# EasyEDA Pro project kuafu01_030内部老化方案_2.eprj

# Schematic Schematic1

## Sheets
1 P1: Create Date: 2023-03-22; Page Name: P1; Project Name: kuafu01_030内部老化方案_2; Schematic Name: Schematic1; Update Date: 2023-04-24; Company: 嘉立创EDA; Page Size: A4; Version: V1.0
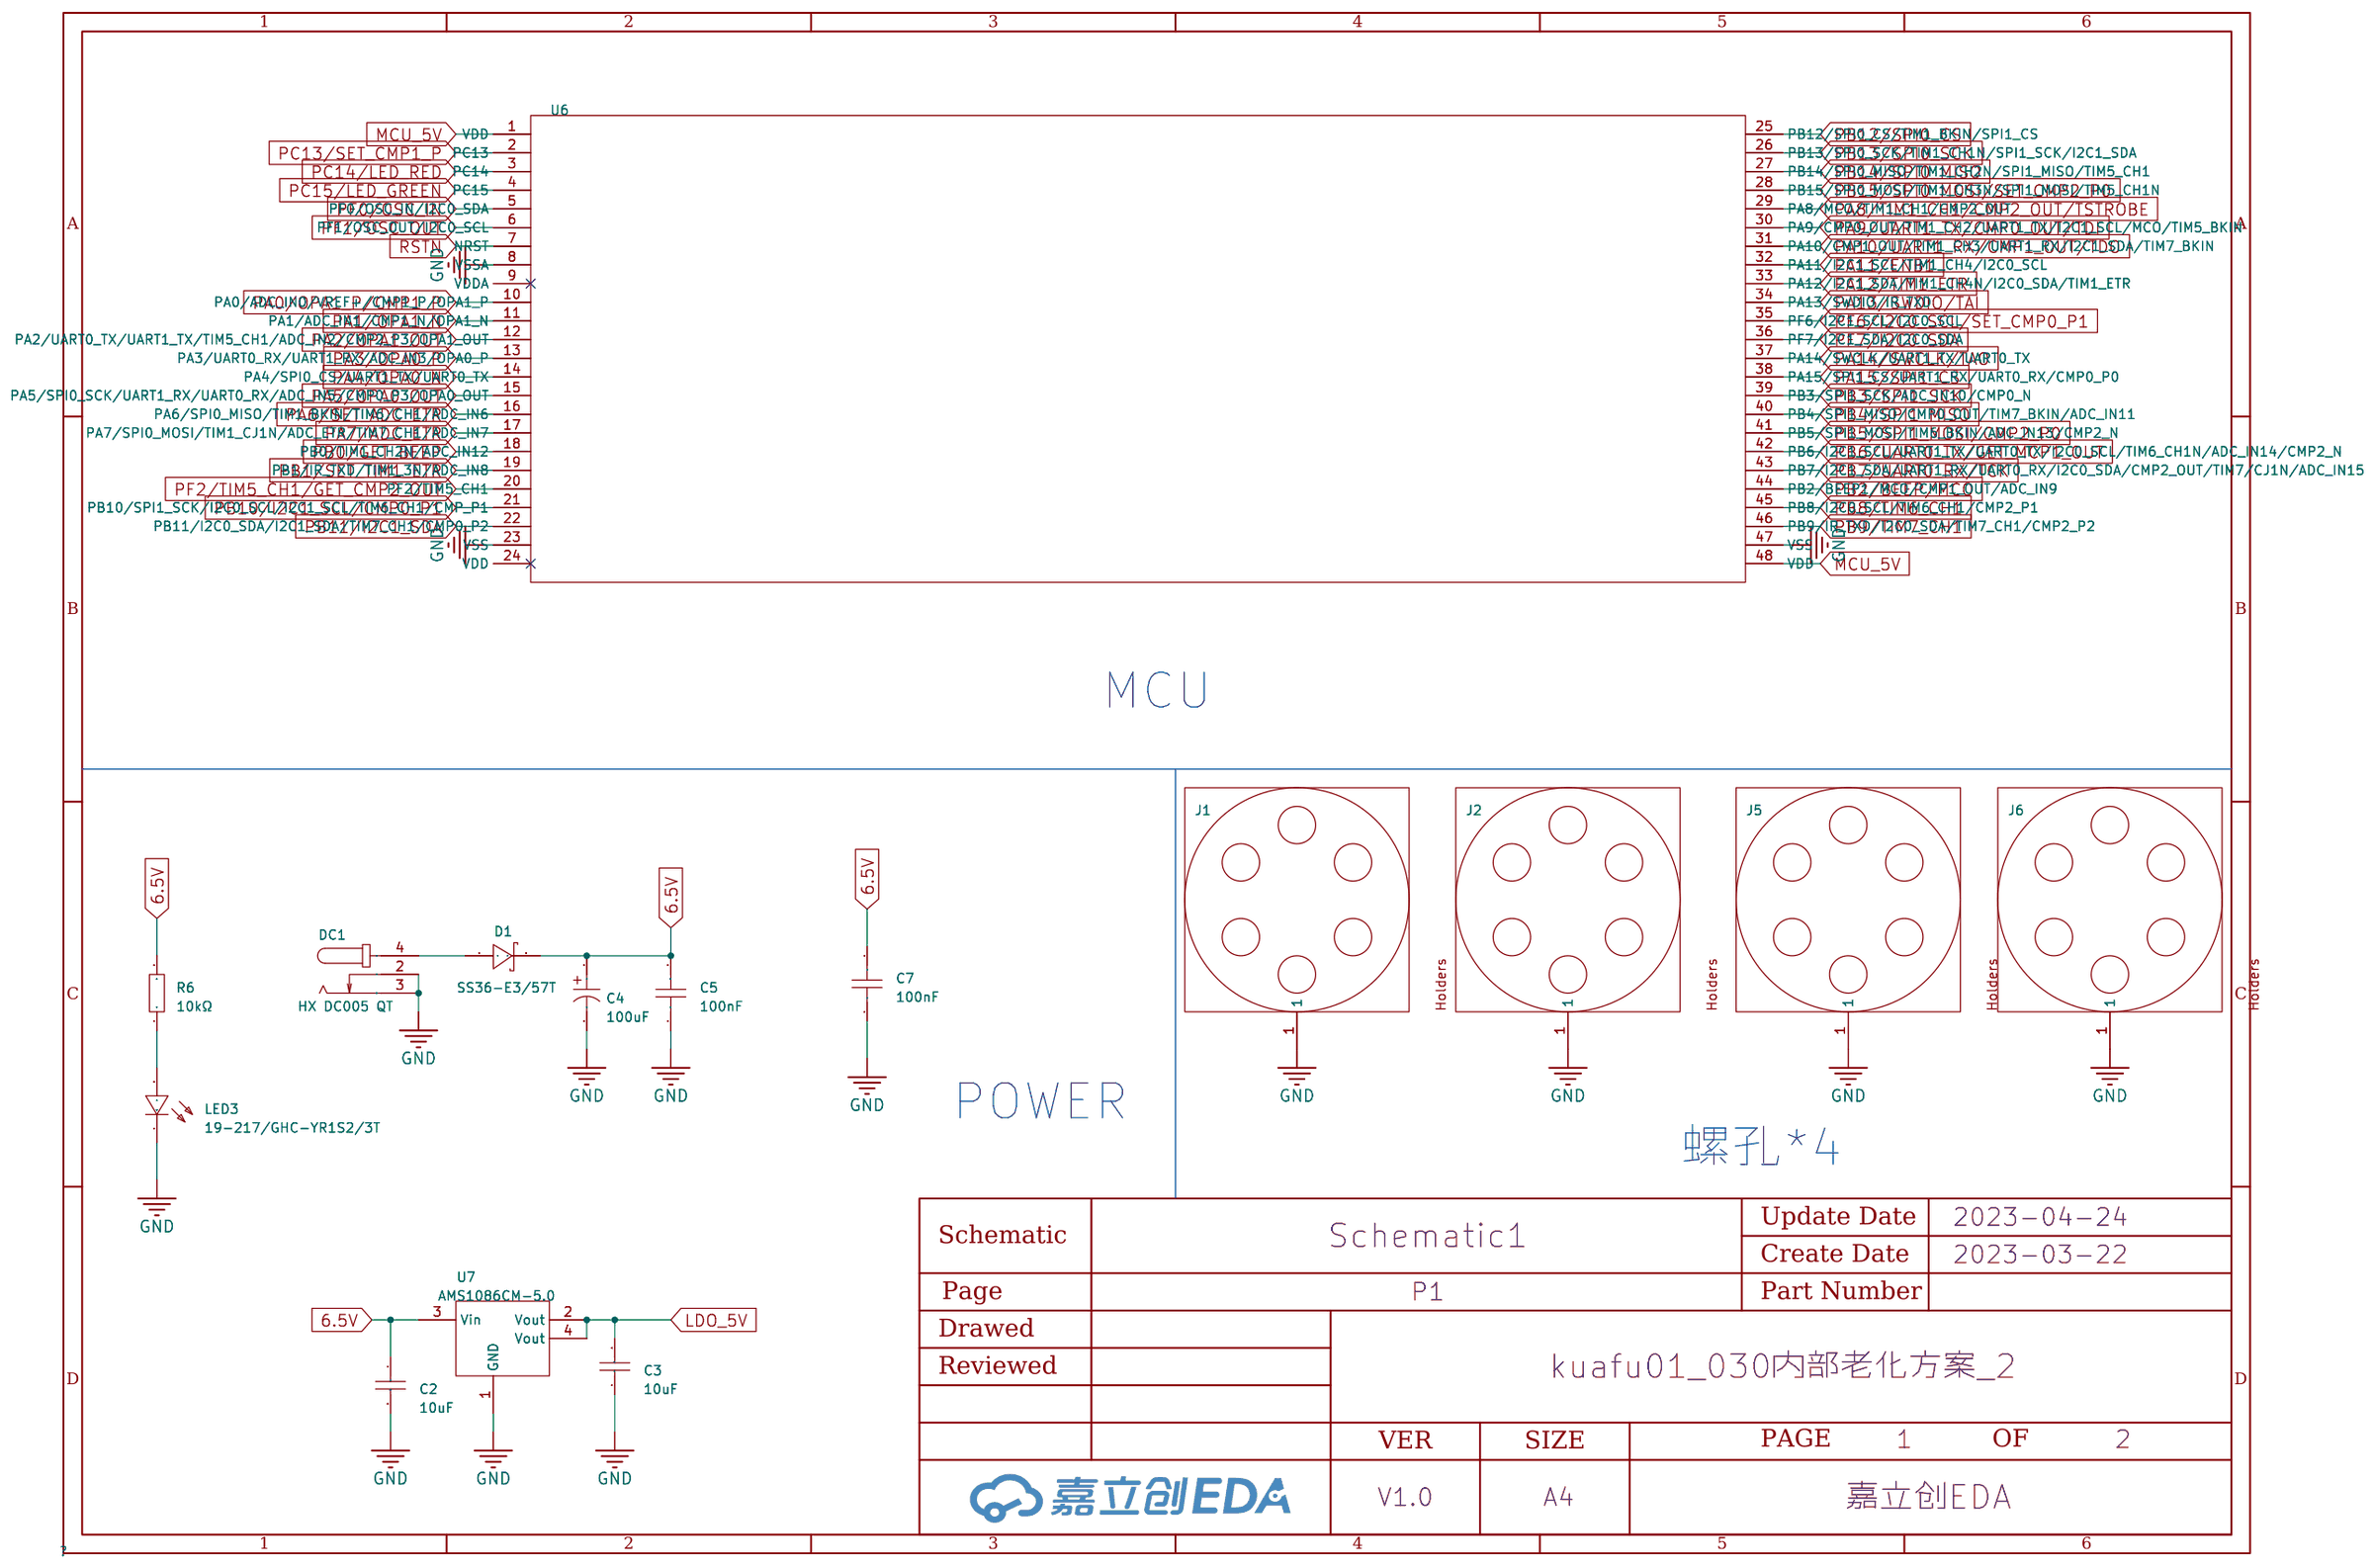
[diagram p0: P1]
2 P2: Create Date: 2023-03-27; Page Name: P2; Update Date: 2023-04-25
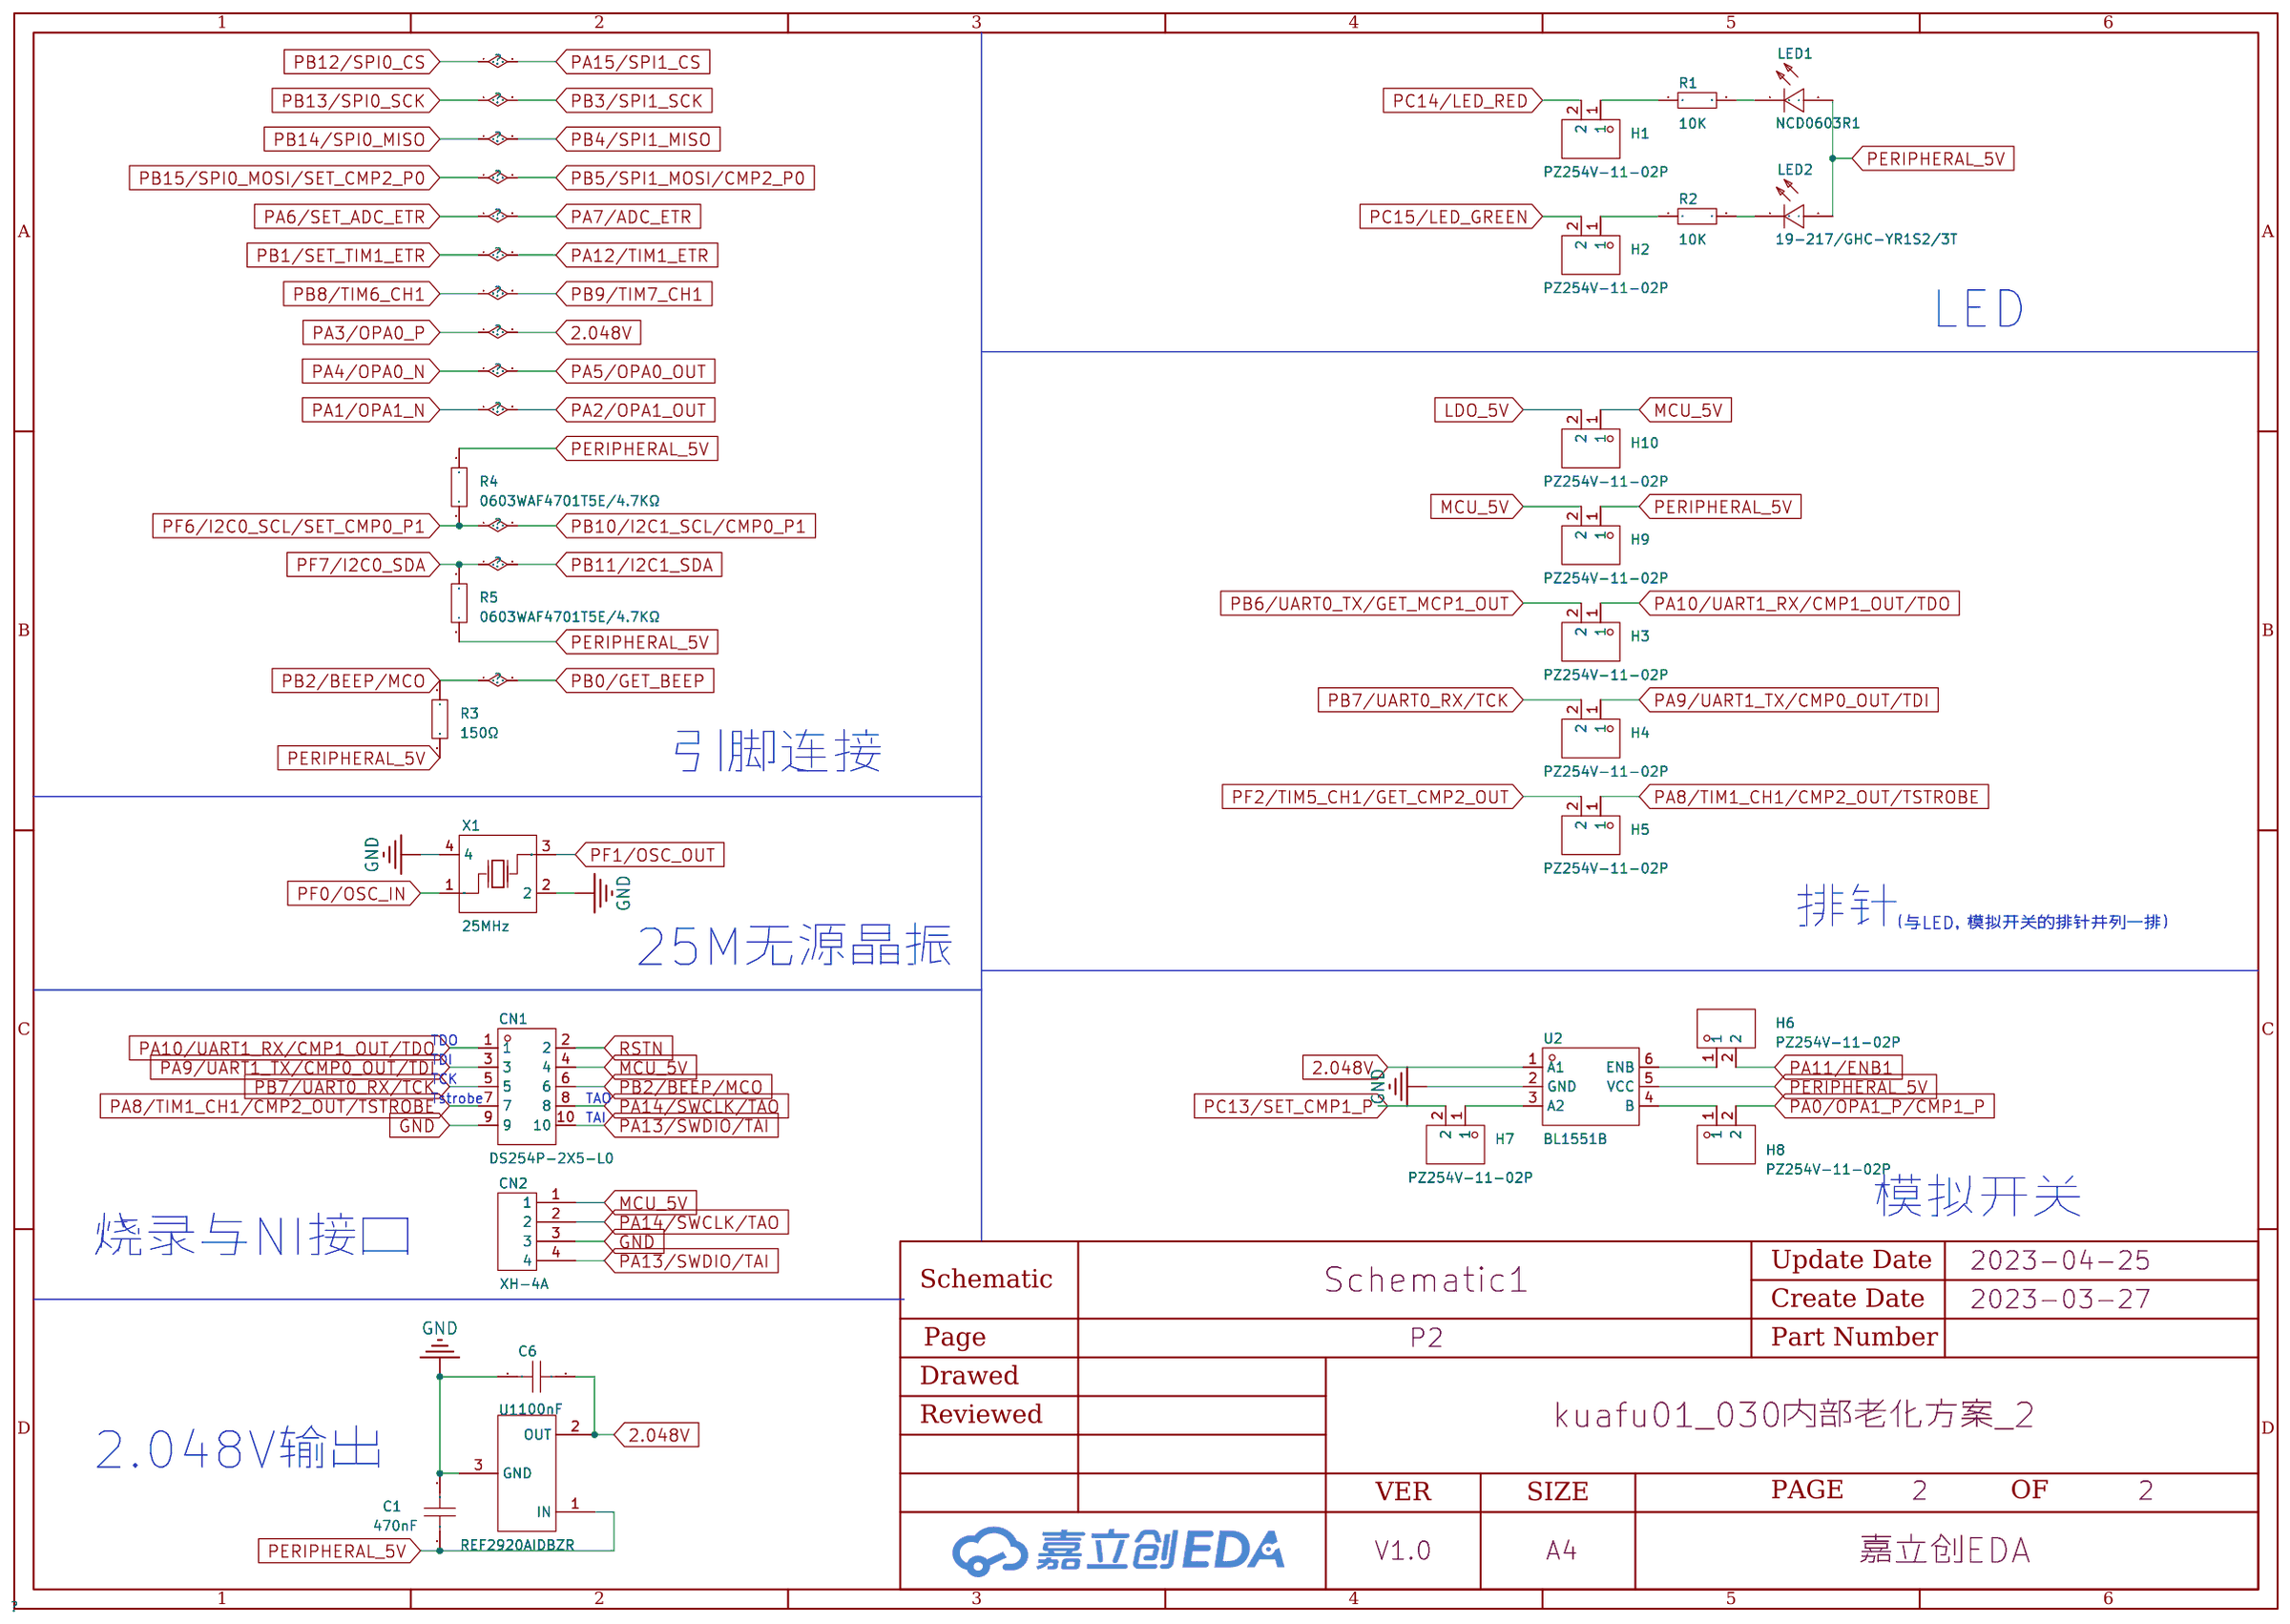
[diagram p1: P2]

## Parts
sheet P1
C2  10uF  [C1206]
C3  10uF  [C1206]
C4  100uF  [CAP-SMD_BD6.3-L6.6-W6.6-LS7.6-FD-1]
C5  100nF  [C0603]
C7  100nF  [C0603]
D1  SS36-E3/57T  [SMC_L7.1-W6.2-LS8.1-R-RD]
DC1  HX DC005 QT  [DC-IN-TH_HANXIA_HX-DC005-QT]
J1  -  [DEMO板安装孔]
J2  -  [DEMO板安装孔]
J5  -  [DEMO板安装孔]
J6  -  [DEMO板安装孔]
LED3  19-217/GHC-YR1S2/3T  [LED0603-RD]
R6  10kΩ  [R0603]
U6  PT32A030C8T7  [LQFP-48_L7.0-W7.0-P0.50-LS9.0-BL-EP5.4]
U7  AMS1086CM-5.0  [TO-263-3_L8.6-W10.2-P2.54-LS14.4-TL]
sheet P2
C1  470nF  [C0603]
C6  100nF  [C0603]
CN1  DS254P-2X5-L0  [IDC-TH_10P-P2.54-V-R2-C5-S2.54]
CN2  XH-4A  [CONN-TH_4P-P2.50_XH-4A]
H1  PZ254V-11-02P  [HDR-TH_2P-P2.54-V-M]
H2  PZ254V-11-02P  [HDR-TH_2P-P2.54-V-M]
H3  PZ254V-11-02P  [HDR-TH_2P-P2.54-V-M]
H4  PZ254V-11-02P  [HDR-TH_2P-P2.54-V-M]
H5  PZ254V-11-02P  [HDR-TH_2P-P2.54-V-M]
H6  PZ254V-11-02P  [HDR-TH_2P-P2.54-V-M]
H7  PZ254V-11-02P  [HDR-TH_2P-P2.54-V-M]
H8  PZ254V-11-02P  [HDR-TH_2P-P2.54-V-M]
H9  PZ254V-11-02P  [HDR-TH_2P-P2.54-V-M]
H10  PZ254V-11-02P  [HDR-TH_2P-P2.54-V-M]
LED1  NCD0603R1  [LED0603-RD_RED]
LED2  19-217/GHC-YR1S2/3T  [LED0603-RD]
R1  10K  [R0603]
R2  10K  [R0603]
R3  150Ω  [R0603]
R4  0603WAF4701T5E/4.7KΩ  [R0603]
R5  0603WAF4701T5E/4.7KΩ  [R0603]
U1  REF2920AIDBZR  [SOT-23-3_L2.9-W1.3-P1.90-LS2.4-BR]
U2  BL1551B  [SC-70-6_L2.1-W1.3-P0.65-LS2.3-BR]
X1  25MHz  [OSC-SMD_4P-L2.5-W2.0-BL]

## Library data of the parts
C2 C3 = CL31A106KBHNNNE: 容值:10uF;精度:±10%;额定电压:50V;材质(温度系数):X5R;; LCSC Part Name: 10uF ±10% 50V; Supplier Part: C13585; Manufacturer: SAMSUNG(三星); Supplier Footprint: 1206; JLCPCB Part Class: Basic Part; Datasheet: https://atta.szlcsc.com/upload/public/pdf/source/20160103/1457707668742.pdf; Supplier: LCSC; Tolerance: ±10%; Voltage Rated: 50V; Temperature Coefficient: X5R
C4 = RVE100UF35V67RV0072: 容值:100uF;额定电压:35V;电容体直径:-;电容体长度:-;纹波电流:-;等效串联电阻:-;工作寿命:-;; LCSC Part Name: 100uF 35V; Supplier Part: C2836437; Manufacturer: KNSCHA(科尼盛); Supplier Footprint: SMD,6.3x7.7mm; JLCPCB Part Class: Extended Part; Datasheet: https://atta.szlcsc.com/upload/public/pdf/source/20220719/B52EB46F8A1558448ED03D8B4CB3C24F.pdf; Supplier: LCSC; Rated Voltage: 35V
C5-C7 = CL10B104KB8NNNC: 容值:100nF;精度:±10%;额定电压:50V;材质(温度系数):X7R;; LCSC Part Name: 100nF ±10% 50V; Supplier Part: C1591; Manufacturer: SAMSUNG(三星); Supplier Footprint: 0603; JLCPCB Part Class: Extended Part; Datasheet: https://atta.szlcsc.com/upload/public/pdf/source/20160103/1457707680512.pdf; Supplier: LCSC; Tolerance: ±10%; Voltage Rated: 50V; Temperature Coefficient: X7R
D1 = SS36-E3/57T: 直流反向耐压（Vr）:60V;平均整流电流（Io）:3A;正向压降（Vf）:750mV @ 3A;; Supplier Part: C35722; Manufacturer: VISHAY(威世); Supplier Footprint: SMC(DO-214AB); JLCPCB Part Class: Basic Part; Datasheet: https://atta.szlcsc.com/upload/public/pdf/source/20151007/1457707426323.pdf; Supplier: LCSC
DC1 = HX DC005 QT: 连接器类型:DC插座;安装方式:卧插;额定电流:1A;额定电压:12V;工作温度范围:-25℃~+85℃;; LCSC Part Name: DC插座; Supplier Part: C5184829; Manufacturer: hanxia(韩下); Supplier Footprint: 插件; JLCPCB Part Class: Extended Part; Datasheet: https://atta.szlcsc.com/upload/public/pdf/source/20220930/72F2DABD42189BF434FA6ABB0C092A1C.pdf; Supplier: LCSC; Connector Type: DC插座; Mounting Style: 卧插; Current Rating (Max): 1A; Voltage Rating (Max): 12V; Operating Temperature Range: -25℃~+85℃
J1 J2 J5 J6 = 螺孔_3.1X6MM
LED2 LED3 = 19-217/GHC-YR1S2/3T: 发光颜色:翠绿;二极管配置:-;透镜颜色:无色透明;主波长:520nm~535nm;峰值波长:518nm;色温:-;测试电流:20mA;功率:110mW;发光角度:120°;安装方式:-;工作温度:-40℃~+85℃;; LCSC Part Name: 翠绿 520nm~535nm; Supplier Part: C72043; Manufacturer: EVERLIGHT(亿光); Supplier Footprint: 0603; JLCPCB Part Class: Basic Part; Datasheet: https://atta.szlcsc.com/upload/public/pdf/source/20160507/1462613613780.pdf; Supplier: LCSC; Emitted Color: 翠绿; Lens Color: 无色透明; Dominant Wavelength: 520nm~535nm; Peak Wavelength: 518nm; Forward Current: 20mA; Power Dissipation: 110mW; Viewing Angle: 120°; Operating Temperature: -40℃~+85℃
R6 = 0603WAF1002T5E: 电阻类型:厚膜电阻;阻值:10kΩ;精度:±1%;功率:100mW;温度系数:±100ppm/℃;最大工作电压:75V;工作温度范围:-55℃~+155℃;; LCSC Part Name: 10kΩ ±1% 100mW; Supplier Part: C25804; Manufacturer: UNI-ROYAL(厚声); Supplier Footprint: 0603; JLCPCB Part Class: Basic Part; Datasheet: https://atta.szlcsc.com/upload/public/pdf/source/20200306/C422600_1E6D84923E4A46A82E41ADD87F860B5C.pdf; Supplier: LCSC; Type: 厚膜电阻; Tolerance: ±1%; Power(Watts): 100mW; Temperature Coefficient: ±100ppm/℃; Overload Voltage (Max): 75V; Operating Temperature Range: -55℃~+155℃
U6 = PT32A030C8T7
U7 = AMS1086CM-5.0: 输出类型:固定;输出极性:正;最大输入电压:15V;输出电压:5V;输出电流:1.5A;电源纹波抑制比(PSRR):68dB@(120Hz);; LCSC Part Name: 输入15V 输出5V 1.5A; Supplier Part: C27631; Manufacturer: AMS; Supplier Footprint: TO-263-3; JLCPCB Part Class: Extended Part; Datasheet: https://atta.szlcsc.com/upload/public/pdf/source/20140314/1457707017583.pdf; Supplier: LCSC; Output Type: 固定; Output Polarity: 正; Number of Outputs: 1; Maximum Input Voltage: 15V; Output Voltage: 5V; Dropout Voltage: 1.5V@(1.5A); Output Current: 1.5A; Power Supply Rejection Ratio (PSRR): 68dB@(120Hz)
C1 = CAP_0603: Supplier Footprint: 0603
CN1 = DS254P-2X5-L0: 封装形式:直插;; Supplier Part: C4749194; Manufacturer: DEALON(德艺隆); Supplier Footprint: 直插,P=2.54mm; JLCPCB Part Class: Extended Part; Datasheet: https://atta.szlcsc.com/upload/public/pdf/source/20220715/65B607CBB33C24A1E64FE679E68C8AAF.pdf; Supplier: LCSC; Holder Type: 直插
CN2 = XH-4A_C37815: 参考系列:XH;间距:2.5mm;插针结构:1x4P;排数:1;每排PIN数:4;行距:-;安装方式:-;触头材质:磷青铜;; LCSC Part Name: XH 2.5mm 1x4P; Supplier Part: C37815; Manufacturer: BOOMELE(博穆精密); Supplier Footprint: 插件,P=2.5mm; JLCPCB Part Class: Extended Part; Datasheet: https://atta.szlcsc.com/upload/public/pdf/source/20170919/C37815_1505787307039977083.pdf; Supplier: LCSC; Reference Series: XH; Pitch: 2.5mm; Pins Structure: 1x4P; Number of Rows: 1; Number of PINs Per Row: 4; Contact Material: 磷青铜
H1-H10 = PZ254V-11-02P: 排数:单排;总PIN位数:2;间距:2.54mm;插针结构:1x2P;行距:-;安装类型:直插;圆针/方针:方针;额定电流:-;额定电压:-;配合针长度:6mm;塑高:2.5mm;端接针长度:3mm;触头材质:黄铜;触头镀层:-;工作温度范围:-40℃~+105℃;颜色:黑色;; LCSC Part Name: 2.54mm 1x2P 直插 方针; Supplier Part: C492401; Manufacturer: XFCN(兴飞); Supplier Footprint: 直插,P=2.54mm; JLCPCB Part Class: Extended Part; Datasheet: https://atta.szlcsc.com/upload/public/pdf/source/20200309/C492401_A812433581A9B211A7FFA413ADDFF0E5.pdf; Supplier: LCSC; Number of Rows: 单排; Number of Pins: 2; Pitch: 2.54mm; Pin Structure: 1x2P; Mounting Type: 直插; Circluar Pins/Square Pins: 方针; Length of Mating Pin: 6mm; Insulation Height: 2.5mm; Length of End Connection Pin: 3mm; Contact Material: 黄铜; Operating Temperature Range: -40℃~+105℃; Color: 黑色
LED1 = NCD0603R1_C84263: 发光颜色:红灯;; LCSC Part Name: 红灯; Supplier Part: C84263; Manufacturer: 国星光电; Supplier Footprint: 0603; JLCPCB Part Class: Extended Part; Datasheet: https://atta.szlcsc.com/upload/public/pdf/source/20200820/C84263_DABC6A75E58F576973B407FDBA283D60.pdf; Supplier: LCSC; Emitted Color: 红灯
R1-R3 = Res_0603: Supplier Footprint: 0603
R4 R5 = 0603WAF4701T5E: LCSC Part Name: 4.7KΩ(4701) ±1% 编带; Supplier Part: C23162; Manufacturer: UNI-ROYAL(厚声); Supplier Footprint: 0603; JLCPCB Part Class: Basic Part; Datasheet: https://atta.szlcsc.com/upload/public/pdf/source/20170920/C23162_1505901109673982545.pdf; Supplier: LCSC
U1 = REF2920AIDBZR: 电压基准类型:串联;输出类型:固定;输入电压:2.098V~5.5V;输出电流:25mA;精度:±2%;温度系数:100ppm/℃;静态电流:59uA;噪声(0.1Hz-10Hz):23uVp-p;噪声(10Hz-10kHz):65uVrms;工作温度:-40℃~+125℃@(Ta);; LCSC Part Name: 串联 25mA; Supplier Part: C111863; Manufacturer: TI(德州仪器); Supplier Footprint: SOT-23; JLCPCB Part Class: Extended Part; Datasheet: https://atta.szlcsc.com/upload/public/pdf/source/20170919/C111863_1505787059229976692.pdf; Supplier: LCSC; Reference Type: 串联; Output Type: 固定; Input Voltage: 2.098V~5.5V; Output Current: 25mA; Tolerance: ±2%; Temperature Coefficient: 100ppm/℃; Supply Current: 59uA; Noise - 1/10Hz to 10Hz: 23uVp-p; Noise - 10Hz to 10kHz: 65uVrms; Operating Temperature: -40℃~+125℃@(Ta)
U2 = BL1551B: Supplier Part: C2944066; Manufacturer: BL(上海贝岭); Supplier Footprint: SC-70-6; JLCPCB Part Class: Extended Part; Datasheet: https://atta.szlcsc.com/upload/public/pdf/source/20220111/7C5AAA5FC97DA844C85990CC55D99B47.pdf; Supplier: LCSC
X1 = ECS-250-10-36Q-AES-TR: 晶振类型:-;频率:25MHz;频率公差:±25ppm;频率稳定度:±50ppm;负载电容:10pF;等效串联电阻(ESR):60Ω;工作温度:-40℃~+125℃;; LCSC Part Name: 25MHz ±25ppm 10pF; Supplier Part: C435199; Manufacturer: ECS; Supplier Footprint: SMD2520-4P; JLCPCB Part Class: Extended Part; Datasheet: https://atta.szlcsc.com/upload/public/pdf/source/20200102/C435199_2BF86DF6FEC67718933C4FC174F98801.pdf; Supplier: LCSC; Frequency Tolerance: ±25ppm; Frequency Stability: ±50ppm; Load Capacitance: 10pF; Equivalent Series Resistance (ESR): 60Ω; Operating Temperature: -40℃~+125℃

## Nets
2.048V: C6.2 U1.2(OUT) U2.1(A1) U6.13(PA3/UART0_RX/UART1_RX/ADC_IN3/OPA0_P)
6.5V: C2.1 C4.1 C5.2 C7.2 D1.2(K) R6.2 U7.3(Vin)
GND: C1.2 C2.2 C3.1 C4.2 C5.1 C6.1 C7.1 CN1.9 CN2.3 DC1.2 DC1.3 J1.1 J2.1 J5.1 J6.1 LED3.1(C) U1.3(GND) U2.2(GND) U6.8(VSSA) U6.23(VSS) U6.47(VSS) U7.1(GND) X1.2 X1.4
LDO_5V: C3.2 H10.2 U7.2(Vout) U7.4(Vout)
MCU_5V: CN1.4 CN2.1 H9.2 H10.1 U6.1(VDD) U6.48(VDD)
PA0/OPA1_P/CMP1_P: H8.2 U6.10(PA0/ADC_IN0/VREF+/CMP1_P/OPA1_P)
PA1/OPA1_N: U6.11(PA1/ADC_IN1/CMP1_N/OPA1_N) U6.12(PA2/UART0_TX/UART1_TX/TIM5_CH1/ADC_IN2/CMP2_P3/OPA1_OUT)
PA4/OPA0_N: U6.14(PA4/SPI0_CS/UART1_TX/UART0_TX) U6.15(PA5/SPI0_SCK/UART1_RX/UART0_RX/ADC_IN5/CMP0_P3/OPA0_OUT)
PA6/SET_ADC_ETR: U6.16(PA6/SPI0_MISO/TIM1_BKIN/TIM6/CH1/ADC_IN6) U6.17(PA7/SPI0_MOSI/TIM1_CJ1N/ADC_ETR/TIM7_CH1/ADC_IN7)
PA8/TIM1_CH1/CMP2_OUT/TSTROBE: CN1.7 H5.1 U6.29(PA8/MCO/TIM1_CH1/CMP2_OUT)
PA9/UART1_TX/CMP0_OUT/TDI: CN1.3 H4.1 U6.30(PA9/CMP0_OUT/TIM1_CH2/UART1_TX/I2C1_SCL/MCO/TIM5_BKIN)
PA10/UART1_RX/CMP1_OUT/TDO: CN1.1 H3.1 U6.31(PA10/CMP1_OUT/TIM1_CH3/UART1_RX/I2C1_SDA/TIM7_BKIN)
PA11/ENB1: H6.2 U6.32(PA11/I2C1_SCL/TIM1_CH4/I2C0_SCL)
PA12/TIM1_ETR: U6.19(PB1/IR_TXD/TIM1_3N/ADC_IN8) U6.33(PA12/I2C1_SDA/TIM1_CH4N/I2C0_SDA/TIM1_ETR)
PA13/SWDIO/TAI: CN1.10 CN2.4 U6.34(PA13/SWDIO/IR_TXD)
PA14/SWCLK/TAO: CN1.8 CN2.2 U6.37(PA14/SWCLK/UART1_TX/UART0_TX)
PA15/SPI1_CS: U6.25(PB12/SPI0_CS/TIM1_BKIN/SPI1_CS) U6.38(PA15/SPI1_CS/UART1_RX/UART0_RX/CMP0_P0)
PB0/GET_BEEP: CN1.6 R3.2 U6.18(PB0/TIM1_CH2N/ADC_IN12) U6.44(PB2/BEEP1/MCO/CMP1_OUT/ADC_IN9)
PB6/UART0_TX/GET_MCP1_OUT: H3.2 U6.42(PB6/I2C1_SCL/UART1_TX/UART0_TX/I2C0_SCL/TIM6_CH1N/ADC_IN14/CMP2_N)
PB7/UART0_RX/TCK: CN1.5 H4.2 U6.43(PB7/I2C1_SDA/UART1_RX/UART0_RX/I2C0_SDA/CMP2_OUT/TIM7/CJ1N/ADC_IN15)
PB8/TIM6_CH1: U6.45(PB8/I2C0_SCL/TIM6_CH1/CMP2_P1) U6.46(PB9/IR_TXD/I2C0_SDA/TIM7_CH1/CMP2_P2)
PB10/I2C1_SCL/CMP0_P1: R4.2 U6.21(PB10/SPI1_SCK/I2C0_SCL/I2C1_SCL/TIM6_CH1/CMP_P1) U6.35(PF6/I2C1_SCL/I2C0_SCL)
PB11/I2C1_SDA: R5.1 U6.22(PB11/I2C0_SDA/I2C1_SDA/TIM7_CH1/CMP0_P2) U6.36(PF7/I2C1_SDA/I2C0_SDA)
PB13/SPI0_SCK: U6.26(PB13/SPI0_SCK/TIM1_CH1N/SPI1_SCK/I2C1_SDA) U6.39(PB3/SPI1_SCK/ADC_IN10/CMP0_N)
PB14/SPI0_MISO: U6.27(PB14/SPI0_MISO/TIM1_CH2N/SPI1_MISO/TIM5_CH1) U6.40(PB4/SPI1_MISO/CMP0_OUT/TIM7_BKIN/ADC_IN11)
PB15/SPI0_MOSI/SET_CMP2_P0: U6.28(PB15/SPI0_MOSI/TIM1_CH3N/SPI1_MOSI/TIM5_CH1N) U6.41(PB5/SPI1_MOSI/TIM6_BKIN/ADC_IN13/CMP2_N)
PC13/SET_CMP1_P: H7.2 U6.2(PC13)
PC14/LED_RED: H1.2 U6.3(PC14)
PC15/LED_GREEN: H2.2 U6.4(PC15)
PERIPHERAL_5V: C1.1 H9.1 LED1.2(A) LED2.2(A) R3.1 R4.1 R5.2 U1.1(IN) U2.5(VCC)
PF0/OSC_IN: U6.5(PF0/OSC_IN/I2C0_SDA) X1.1(OSC1)
PF1/OSC_OUT: U6.6(PF1/OSC_OUT/I2C0_SCL) X1.3(OSC2)
PF2/TIM5_CH1/GET_CMP2_OUT: H5.2 U6.20(PF2/TIM5_CH1)
RSTN: CN1.2 U6.7(NRST)
$3N9153: D1.1(A) DC1.4
$3N9301: LED3.2(A) R6.1
$4N6329: LED2.1(C) R2.2
$4N6330: LED1.1(K) R1.2
$4N10186: H7.1 U2.3(A2)
$4N10193: H6.1 U2.6(ENB)
$4N10258: H2.1 R2.1
$4N10262: H1.1 R1.1
$4N16114: H8.1 U2.4(B)

Not connected (* = marked no-connect by the designer): U6 9(VDDA)* 24(VDD)*

## Notes on the sheets
sheet 1
- MCU
- POWER
- 螺孔*4
sheet 2
- LED
- 引脚连接
- 排针
- （与LED，模拟开关的排针并列一排）
- 25M无源晶振
- TDO
- TDI
- TCK
- Tstrobe
- TAO
- TAI
- 模拟开关
- 烧录与NI接口
- 2.048V输出

# Board PCB4
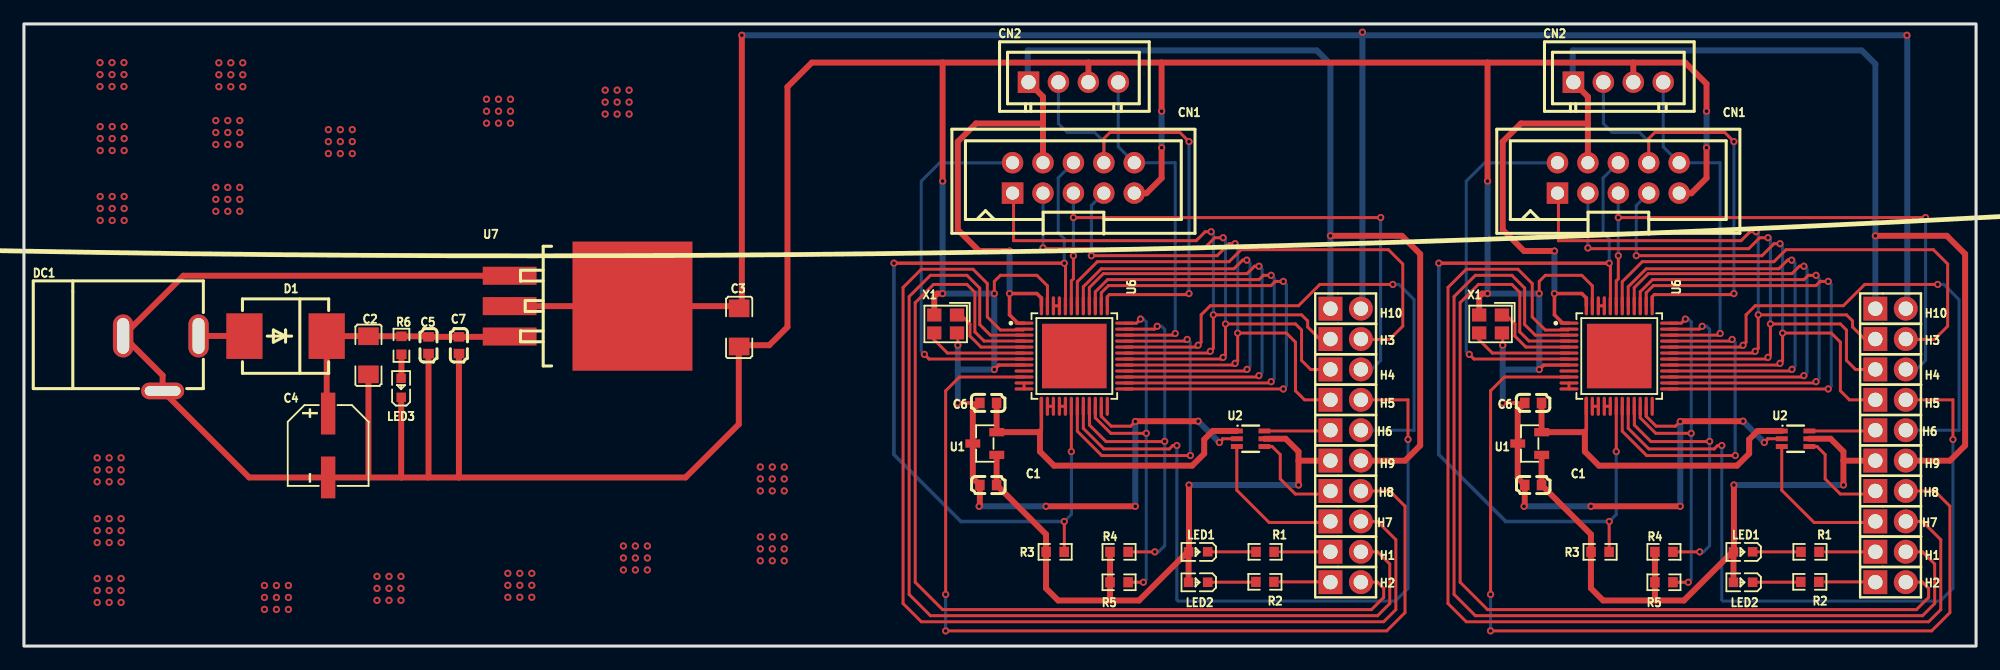
[diagram p2: board, top side]